# EAGLE schematic Resistor_Resistor (EAGLE 8.3.0), part 38 of 43
## Nets (continued)
N$133: R24801.2 R24802.2 R24803.2 R24804.2 R24805.2 R24806.2 R24807.2 R24808.2 R24809.2 R24810.2 R24811.2 R24812.2 R24813.2 R24814.2 R24815.2 R24816.2 R24817.2 R24818.2 R24819.2 R24820.2 R24821.2 R24822.2 R24823.2 R24824.2 R24825.2 R24826.2 R24827.2 R24828.2 R24829.2 R24830.2 R24831.2 R24832.2 R24833.2 R24834.2 R24835.2 R24836.2 R24837.2 R24838.2 R24839.2 R24840.2 R24841.2 R24842.2 R24843.2 R24844.2 R24845.2 R24846.2 R24847.2 R24848.2 R24849.2 R24850.2 R24851.2 R24852.2 R24853.2 R24854.2 R24855.2 R24856.2 R24857.2 R24858.2 R24859.2 R24860.2 R24861.2 R24862.2 R24863.2 R24864.2 R24865.2 R24866.2 R24867.2 R24868.2 R24869.2 R24870.2 R24871.2 R24872.2 R24873.2 R24874.2 R24875.2 R24876.2 R24877.2 R24878.2 R24879.2 R24880.2 R24881.2 R24882.2 R24883.2 R24884.2 R24885.2 R24886.2 R24887.2 R24888.2 R24889.2 R24890.2 R24891.2 R24892.2 R24893.2 R24894.2 R24895.2 R24896.2 R24897.2 R24898.2 R24899.2 R24900.2 R24901.2 R24902.2 R24903.2 R24904.2 R24905.2 R24906.2 R24907.2 R24908.2 R24909.2 R24910.2 R24911.2 R24912.2 R24913.2 R24914.2 R24915.2 R24916.2 R24917.2 R24918.2 R24919.2 R24920.2 R24921.2 R24922.2 R24923.2 R24924.2 R24925.2 R24926.2 R24927.2 R24928.2 R24929.2 R24930.2 R24931.2 R24932.2 R24933.2 R24934.2 R24935.2 R24936.2 R24937.2 R24938.2 R24939.2 R24940.2 R24941.2 R24942.2 R24943.2 R24944.2 R24945.2 R24946.2 R24947.2 R24948.2 R24949.2 R24950.2 R24951.2 R24952.2 R24953.2 R24954.2 R24955.2 R24956.2 R24957.2 R24958.2 R24959.2 R24960.2 R24961.2 R24962.2 R24963.2 R24964.2 R24965.2 R24966.2 R24967.2 R24968.2 R24969.2 R24970.2 R24971.2 R24972.2 R24973.2 R24974.2 R24975.2 R24976.2 R24977.2 R24978.2 R24979.2 R24980.2 R24981.2 R24982.2 R24983.2 R24984.2 R24985.2 R24986.2 R24987.2 R24988.2 R24989.2 R24990.2 R24991.2 R24992.2 R24993.2 R24994.2 R24995.2 R24996.2 R24997.2 R24998.2 R24999.2 R25000.2 R25001.1 R25002.1 R25003.1 R25004.1 R25005.1 R25006.1 R25007.1 R25008.1 R25009.1 R25010.1 R25011.1 R25012.1 R25013.1 R25014.1 R25015.1 R25016.1 R25017.1 R25018.1 R25019.1 R25020.1 R25021.1 R25022.1 R25023.1 R25024.1 R25025.1 R25026.1 R25027.1 R25028.1 R25029.1 R25030.1 R25031.1 R25032.1 R25033.1 R25034.1 R25035.1 R25036.1 R25037.1 R25038.1 R25039.1 R25040.1 R25041.1 R25042.1 R25043.1 R25044.1 R25045.1 R25046.1 R25047.1 R25048.1 R25049.1 R25050.1 R25051.1 R25052.1 R25053.1 R25054.1 R25055.1 R25056.1 R25057.1 R25058.1 R25059.1 R25060.1 R25061.1 R25062.1 R25063.1 R25064.1 R25065.1 R25066.1 R25067.1 R25068.1 R25069.1 R25070.1 R25071.1 R25072.1 R25073.1 R25074.1 R25075.1 R25076.1 R25077.1 R25078.1 R25079.1 R25080.1 R25081.1 R25082.1 R25083.1 R25084.1 R25085.1 R25086.1 R25087.1 R25088.1 R25089.1 R25090.1 R25091.1 R25092.1 R25093.1 R25094.1 R25095.1 R25096.1 R25097.1 R25098.1 R25099.1 R25100.1 R25101.1 R25102.1 R25103.1 R25104.1 R25105.1 R25106.1 R25107.1 R25108.1 R25109.1 R25110.1 R25111.1 R25112.1 R25113.1 R25114.1 R25115.1 R25116.1 R25117.1 R25118.1 R25119.1 R25120.1 R25121.1 R25122.1 R25123.1 R25124.1 R25125.1 R25126.1 R25127.1 R25128.1 R25129.1 R25130.1 R25131.1 R25132.1 R25133.1 R25134.1 R25135.1 R25136.1 R25137.1 R25138.1 R25139.1 R25140.1 R25141.1 R25142.1 R25143.1 R25144.1 R25145.1 R25146.1 R25147.1 R25148.1 R25149.1 R25150.1 R25151.1 R25152.1 R25153.1 R25154.1 R25155.1 R25156.1 R25157.1 R25158.1 R25159.1 R25160.1 R25161.1 R25162.1 R25163.1 R25164.1 R25165.1 R25166.1 R25167.1 R25168.1 R25169.1 R25170.1 R25171.1 R25172.1 R25173.1 R25174.1 R25175.1 R25176.1 R25177.1 R25178.1 R25179.1 R25180.1 R25181.1 R25182.1 R25183.1 R25184.1 R25185.1 R25186.1 R25187.1 R25188.1 R25189.1 R25190.1 R25191.1 R25192.1 R25193.1 R25194.1 R25195.1 R25196.1 R25197.1 R25198.1 R25199.1 R25200.1
N$134: R25001.2 R25002.2 R25003.2 R25004.2 R25005.2 R25006.2 R25007.2 R25008.2 R25009.2 R25010.2 R25011.2 R25012.2 R25013.2 R25014.2 R25015.2 R25016.2 R25017.2 R25018.2 R25019.2 R25020.2 R25021.2 R25022.2 R25023.2 R25024.2 R25025.2 R25026.2 R25027.2 R25028.2 R25029.2 R25030.2 R25031.2 R25032.2 R25033.2 R25034.2 R25035.2 R25036.2 R25037.2 R25038.2 R25039.2 R25040.2 R25041.2 R25042.2 R25043.2 R25044.2 R25045.2 R25046.2 R25047.2 R25048.2 R25049.2 R25050.2 R25051.2 R25052.2 R25053.2 R25054.2 R25055.2 R25056.2 R25057.2 R25058.2 R25059.2 R25060.2 R25061.2 R25062.2 R25063.2 R25064.2 R25065.2 R25066.2 R25067.2 R25068.2 R25069.2 R25070.2 R25071.2 R25072.2 R25073.2 R25074.2 R25075.2 R25076.2 R25077.2 R25078.2 R25079.2 R25080.2 R25081.2 R25082.2 R25083.2 R25084.2 R25085.2 R25086.2 R25087.2 R25088.2 R25089.2 R25090.2 R25091.2 R25092.2 R25093.2 R25094.2 R25095.2 R25096.2 R25097.2 R25098.2 R25099.2 R25100.2 R25101.2 R25102.2 R25103.2 R25104.2 R25105.2 R25106.2 R25107.2 R25108.2 R25109.2 R25110.2 R25111.2 R25112.2 R25113.2 R25114.2 R25115.2 R25116.2 R25117.2 R25118.2 R25119.2 R25120.2 R25121.2 R25122.2 R25123.2 R25124.2 R25125.2 R25126.2 R25127.2 R25128.2 R25129.2 R25130.2 R25131.2 R25132.2 R25133.2 R25134.2 R25135.2 R25136.2 R25137.2 R25138.2 R25139.2 R25140.2 R25141.2 R25142.2 R25143.2 R25144.2 R25145.2 R25146.2 R25147.2 R25148.2 R25149.2 R25150.2 R25151.2 R25152.2 R25153.2 R25154.2 R25155.2 R25156.2 R25157.2 R25158.2 R25159.2 R25160.2 R25161.2 R25162.2 R25163.2 R25164.2 R25165.2 R25166.2 R25167.2 R25168.2 R25169.2 R25170.2 R25171.2 R25172.2 R25173.2 R25174.2 R25175.2 R25176.2 R25177.2 R25178.2 R25179.2 R25180.2 R25181.2 R25182.2 R25183.2 R25184.2 R25185.2 R25186.2 R25187.2 R25188.2 R25189.2 R25190.2 R25191.2 R25192.2 R25193.2 R25194.2 R25195.2 R25196.2 R25197.2 R25198.2 R25199.2 R25200.2 R25201.1 R25202.1 R25203.1 R25204.1 R25205.1 R25206.1 R25207.1 R25208.1 R25209.1 R25210.1 R25211.1 R25212.1 R25213.1 R25214.1 R25215.1 R25216.1 R25217.1 R25218.1 R25219.1 R25220.1 R25221.1 R25222.1 R25223.1 R25224.1 R25225.1 R25226.1 R25227.1 R25228.1 R25229.1 R25230.1 R25231.1 R25232.1 R25233.1 R25234.1 R25235.1 R25236.1 R25237.1 R25238.1 R25239.1 R25240.1 R25241.1 R25242.1 R25243.1 R25244.1 R25245.1 R25246.1 R25247.1 R25248.1 R25249.1 R25250.1 R25251.1 R25252.1 R25253.1 R25254.1 R25255.1 R25256.1 R25257.1 R25258.1 R25259.1 R25260.1 R25261.1 R25262.1 R25263.1 R25264.1 R25265.1 R25266.1 R25267.1 R25268.1 R25269.1 R25270.1 R25271.1 R25272.1 R25273.1 R25274.1 R25275.1 R25276.1 R25277.1 R25278.1 R25279.1 R25280.1 R25281.1 R25282.1 R25283.1 R25284.1 R25285.1 R25286.1 R25287.1 R25288.1 R25289.1 R25290.1 R25291.1 R25292.1 R25293.1 R25294.1 R25295.1 R25296.1 R25297.1 R25298.1 R25299.1 R25300.1 R25301.1 R25302.1 R25303.1 R25304.1 R25305.1 R25306.1 R25307.1 R25308.1 R25309.1 R25310.1 R25311.1 R25312.1 R25313.1 R25314.1 R25315.1 R25316.1 R25317.1 R25318.1 R25319.1 R25320.1 R25321.1 R25322.1 R25323.1 R25324.1 R25325.1 R25326.1 R25327.1 R25328.1 R25329.1 R25330.1 R25331.1 R25332.1 R25333.1 R25334.1 R25335.1 R25336.1 R25337.1 R25338.1 R25339.1 R25340.1 R25341.1 R25342.1 R25343.1 R25344.1 R25345.1 R25346.1 R25347.1 R25348.1 R25349.1 R25350.1 R25351.1 R25352.1 R25353.1 R25354.1 R25355.1 R25356.1 R25357.1 R25358.1 R25359.1 R25360.1 R25361.1 R25362.1 R25363.1 R25364.1 R25365.1 R25366.1 R25367.1 R25368.1 R25369.1 R25370.1 R25371.1 R25372.1 R25373.1 R25374.1 R25375.1 R25376.1 R25377.1 R25378.1 R25379.1 R25380.1 R25381.1 R25382.1 R25383.1 R25384.1 R25385.1 R25386.1 R25387.1 R25388.1 R25389.1 R25390.1 R25391.1 R25392.1 R25393.1 R25394.1 R25395.1 R25396.1 R25397.1 R25398.1 R25399.1 R25400.1
N$135: R25201.2 R25202.2 R25203.2 R25204.2 R25205.2 R25206.2 R25207.2 R25208.2 R25209.2 R25210.2 R25211.2 R25212.2 R25213.2 R25214.2 R25215.2 R25216.2 R25217.2 R25218.2 R25219.2 R25220.2 R25221.2 R25222.2 R25223.2 R25224.2 R25225.2 R25226.2 R25227.2 R25228.2 R25229.2 R25230.2 R25231.2 R25232.2 R25233.2 R25234.2 R25235.2 R25236.2 R25237.2 R25238.2 R25239.2 R25240.2 R25241.2 R25242.2 R25243.2 R25244.2 R25245.2 R25246.2 R25247.2 R25248.2 R25249.2 R25250.2 R25251.2 R25252.2 R25253.2 R25254.2 R25255.2 R25256.2 R25257.2 R25258.2 R25259.2 R25260.2 R25261.2 R25262.2 R25263.2 R25264.2 R25265.2 R25266.2 R25267.2 R25268.2 R25269.2 R25270.2 R25271.2 R25272.2 R25273.2 R25274.2 R25275.2 R25276.2 R25277.2 R25278.2 R25279.2 R25280.2 R25281.2 R25282.2 R25283.2 R25284.2 R25285.2 R25286.2 R25287.2 R25288.2 R25289.2 R25290.2 R25291.2 R25292.2 R25293.2 R25294.2 R25295.2 R25296.2 R25297.2 R25298.2 R25299.2 R25300.2 R25301.2 R25302.2 R25303.2 R25304.2 R25305.2 R25306.2 R25307.2 R25308.2 R25309.2 R25310.2 R25311.2 R25312.2 R25313.2 R25314.2 R25315.2 R25316.2 R25317.2 R25318.2 R25319.2 R25320.2 R25321.2 R25322.2 R25323.2 R25324.2 R25325.2 R25326.2 R25327.2 R25328.2 R25329.2 R25330.2 R25331.2 R25332.2 R25333.2 R25334.2 R25335.2 R25336.2 R25337.2 R25338.2 R25339.2 R25340.2 R25341.2 R25342.2 R25343.2 R25344.2 R25345.2 R25346.2 R25347.2 R25348.2 R25349.2 R25350.2 R25351.2 R25352.2 R25353.2 R25354.2 R25355.2 R25356.2 R25357.2 R25358.2 R25359.2 R25360.2 R25361.2 R25362.2 R25363.2 R25364.2 R25365.2 R25366.2 R25367.2 R25368.2 R25369.2 R25370.2 R25371.2 R25372.2 R25373.2 R25374.2 R25375.2 R25376.2 R25377.2 R25378.2 R25379.2 R25380.2 R25381.2 R25382.2 R25383.2 R25384.2 R25385.2 R25386.2 R25387.2 R25388.2 R25389.2 R25390.2 R25391.2 R25392.2 R25393.2 R25394.2 R25395.2 R25396.2 R25397.2 R25398.2 R25399.2 R25400.2 R25401.1 R25402.1 R25403.1 R25404.1 R25405.1 R25406.1 R25407.1 R25408.1 R25409.1 R25410.1 R25411.1 R25412.1 R25413.1 R25414.1 R25415.1 R25416.1 R25417.1 R25418.1 R25419.1 R25420.1 R25421.1 R25422.1 R25423.1 R25424.1 R25425.1 R25426.1 R25427.1 R25428.1 R25429.1 R25430.1 R25431.1 R25432.1 R25433.1 R25434.1 R25435.1 R25436.1 R25437.1 R25438.1 R25439.1 R25440.1 R25441.1 R25442.1 R25443.1 R25444.1 R25445.1 R25446.1 R25447.1 R25448.1 R25449.1 R25450.1 R25451.1 R25452.1 R25453.1 R25454.1 R25455.1 R25456.1 R25457.1 R25458.1 R25459.1 R25460.1 R25461.1 R25462.1 R25463.1 R25464.1 R25465.1 R25466.1 R25467.1 R25468.1 R25469.1 R25470.1 R25471.1 R25472.1 R25473.1 R25474.1 R25475.1 R25476.1 R25477.1 R25478.1 R25479.1 R25480.1 R25481.1 R25482.1 R25483.1 R25484.1 R25485.1 R25486.1 R25487.1 R25488.1 R25489.1 R25490.1 R25491.1 R25492.1 R25493.1 R25494.1 R25495.1 R25496.1 R25497.1 R25498.1 R25499.1 R25500.1 R25501.1 R25502.1 R25503.1 R25504.1 R25505.1 R25506.1 R25507.1 R25508.1 R25509.1 R25510.1 R25511.1 R25512.1 R25513.1 R25514.1 R25515.1 R25516.1 R25517.1 R25518.1 R25519.1 R25520.1 R25521.1 R25522.1 R25523.1 R25524.1 R25525.1 R25526.1 R25527.1 R25528.1 R25529.1 R25530.1 R25531.1 R25532.1 R25533.1 R25534.1 R25535.1 R25536.1 R25537.1 R25538.1 R25539.1 R25540.1 R25541.1 R25542.1 R25543.1 R25544.1 R25545.1 R25546.1 R25547.1 R25548.1 R25549.1 R25550.1 R25551.1 R25552.1 R25553.1 R25554.1 R25555.1 R25556.1 R25557.1 R25558.1 R25559.1 R25560.1 R25561.1 R25562.1 R25563.1 R25564.1 R25565.1 R25566.1 R25567.1 R25568.1 R25569.1 R25570.1 R25571.1 R25572.1 R25573.1 R25574.1 R25575.1 R25576.1 R25577.1 R25578.1 R25579.1 R25580.1 R25581.1 R25582.1 R25583.1 R25584.1 R25585.1 R25586.1 R25587.1 R25588.1 R25589.1 R25590.1 R25591.1 R25592.1 R25593.1 R25594.1 R25595.1 R25596.1 R25597.1 R25598.1 R25599.1 R25600.1
N$136: R25401.2 R25402.2 R25403.2 R25404.2 R25405.2 R25406.2 R25407.2 R25408.2 R25409.2 R25410.2 R25411.2 R25412.2 R25413.2 R25414.2 R25415.2 R25416.2 R25417.2 R25418.2 R25419.2 R25420.2 R25421.2 R25422.2 R25423.2 R25424.2 R25425.2 R25426.2 R25427.2 R25428.2 R25429.2 R25430.2 R25431.2 R25432.2 R25433.2 R25434.2 R25435.2 R25436.2 R25437.2 R25438.2 R25439.2 R25440.2 R25441.2 R25442.2 R25443.2 R25444.2 R25445.2 R25446.2 R25447.2 R25448.2 R25449.2 R25450.2 R25451.2 R25452.2 R25453.2 R25454.2 R25455.2 R25456.2 R25457.2 R25458.2 R25459.2 R25460.2 R25461.2 R25462.2 R25463.2 R25464.2 R25465.2 R25466.2 R25467.2 R25468.2 R25469.2 R25470.2 R25471.2 R25472.2 R25473.2 R25474.2 R25475.2 R25476.2 R25477.2 R25478.2 R25479.2 R25480.2 R25481.2 R25482.2 R25483.2 R25484.2 R25485.2 R25486.2 R25487.2 R25488.2 R25489.2 R25490.2 R25491.2 R25492.2 R25493.2 R25494.2 R25495.2 R25496.2 R25497.2 R25498.2 R25499.2 R25500.2 R25501.2 R25502.2 R25503.2 R25504.2 R25505.2 R25506.2 R25507.2 R25508.2 R25509.2 R25510.2 R25511.2 R25512.2 R25513.2 R25514.2 R25515.2 R25516.2 R25517.2 R25518.2 R25519.2 R25520.2 R25521.2 R25522.2 R25523.2 R25524.2 R25525.2 R25526.2 R25527.2 R25528.2 R25529.2 R25530.2 R25531.2 R25532.2 R25533.2 R25534.2 R25535.2 R25536.2 R25537.2 R25538.2 R25539.2 R25540.2 R25541.2 R25542.2 R25543.2 R25544.2 R25545.2 R25546.2 R25547.2 R25548.2 R25549.2 R25550.2 R25551.2 R25552.2 R25553.2 R25554.2 R25555.2 R25556.2 R25557.2 R25558.2 R25559.2 R25560.2 R25561.2 R25562.2 R25563.2 R25564.2 R25565.2 R25566.2 R25567.2 R25568.2 R25569.2 R25570.2 R25571.2 R25572.2 R25573.2 R25574.2 R25575.2 R25576.2 R25577.2 R25578.2 R25579.2 R25580.2 R25581.2 R25582.2 R25583.2 R25584.2 R25585.2 R25586.2 R25587.2 R25588.2 R25589.2 R25590.2 R25591.2 R25592.2 R25593.2 R25594.2 R25595.2 R25596.2 R25597.2 R25598.2 R25599.2 R25600.2 R25601.1 R25602.1 R25603.1 R25604.1 R25605.1 R25606.1 R25607.1 R25608.1 R25609.1 R25610.1 R25611.1 R25612.1 R25613.1 R25614.1 R25615.1 R25616.1 R25617.1 R25618.1 R25619.1 R25620.1 R25621.1 R25622.1 R25623.1 R25624.1 R25625.1 R25626.1 R25627.1 R25628.1 R25629.1 R25630.1 R25631.1 R25632.1 R25633.1 R25634.1 R25635.1 R25636.1 R25637.1 R25638.1 R25639.1 R25640.1 R25641.1 R25642.1 R25643.1 R25644.1 R25645.1 R25646.1 R25647.1 R25648.1 R25649.1 R25650.1 R25651.1 R25652.1 R25653.1 R25654.1 R25655.1 R25656.1 R25657.1 R25658.1 R25659.1 R25660.1 R25661.1 R25662.1 R25663.1 R25664.1 R25665.1 R25666.1 R25667.1 R25668.1 R25669.1 R25670.1 R25671.1 R25672.1 R25673.1 R25674.1 R25675.1 R25676.1 R25677.1 R25678.1 R25679.1 R25680.1 R25681.1 R25682.1 R25683.1 R25684.1 R25685.1 R25686.1 R25687.1 R25688.1 R25689.1 R25690.1 R25691.1 R25692.1 R25693.1 R25694.1 R25695.1 R25696.1 R25697.1 R25698.1 R25699.1 R25700.1 R25701.1 R25702.1 R25703.1 R25704.1 R25705.1 R25706.1 R25707.1 R25708.1 R25709.1 R25710.1 R25711.1 R25712.1 R25713.1 R25714.1 R25715.1 R25716.1 R25717.1 R25718.1 R25719.1 R25720.1 R25721.1 R25722.1 R25723.1 R25724.1 R25725.1 R25726.1 R25727.1 R25728.1 R25729.1 R25730.1 R25731.1 R25732.1 R25733.1 R25734.1 R25735.1 R25736.1 R25737.1 R25738.1 R25739.1 R25740.1 R25741.1 R25742.1 R25743.1 R25744.1 R25745.1 R25746.1 R25747.1 R25748.1 R25749.1 R25750.1 R25751.1 R25752.1 R25753.1 R25754.1 R25755.1 R25756.1 R25757.1 R25758.1 R25759.1 R25760.1 R25761.1 R25762.1 R25763.1 R25764.1 R25765.1 R25766.1 R25767.1 R25768.1 R25769.1 R25770.1 R25771.1 R25772.1 R25773.1 R25774.1 R25775.1 R25776.1 R25777.1 R25778.1 R25779.1 R25780.1 R25781.1 R25782.1 R25783.1 R25784.1 R25785.1 R25786.1 R25787.1 R25788.1 R25789.1 R25790.1 R25791.1 R25792.1 R25793.1 R25794.1 R25795.1 R25796.1 R25797.1 R25798.1 R25799.1 R25800.1
N$138: R25601.2 R25602.2 R25603.2 R25604.2 R25605.2 R25606.2 R25607.2 R25608.2 R25609.2 R25610.2 R25611.2 R25612.2 R25613.2 R25614.2 R25615.2 R25616.2 R25617.2 R25618.2 R25619.2 R25620.2 R25621.2 R25622.2 R25623.2 R25624.2 R25625.2 R25626.2 R25627.2 R25628.2 R25629.2 R25630.2 R25631.2 R25632.2 R25633.2 R25634.2 R25635.2 R25636.2 R25637.2 R25638.2 R25639.2 R25640.2 R25641.2 R25642.2 R25643.2 R25644.2 R25645.2 R25646.2 R25647.2 R25648.2 R25649.2 R25650.2 R25651.2 R25652.2 R25653.2 R25654.2 R25655.2 R25656.2 R25657.2 R25658.2 R25659.2 R25660.2 R25661.2 R25662.2 R25663.2 R25664.2 R25665.2 R25666.2 R25667.2 R25668.2 R25669.2 R25670.2 R25671.2 R25672.2 R25673.2 R25674.2 R25675.2 R25676.2 R25677.2 R25678.2 R25679.2 R25680.2 R25681.2 R25682.2 R25683.2 R25684.2 R25685.2 R25686.2 R25687.2 R25688.2 R25689.2 R25690.2 R25691.2 R25692.2 R25693.2 R25694.2 R25695.2 R25696.2 R25697.2 R25698.2 R25699.2 R25700.2 R25701.2 R25702.2 R25703.2 R25704.2 R25705.2 R25706.2 R25707.2 R25708.2 R25709.2 R25710.2 R25711.2 R25712.2 R25713.2 R25714.2 R25715.2 R25716.2 R25717.2 R25718.2 R25719.2 R25720.2 R25721.2 R25722.2 R25723.2 R25724.2 R25725.2 R25726.2 R25727.2 R25728.2 R25729.2 R25730.2 R25731.2 R25732.2 R25733.2 R25734.2 R25735.2 R25736.2 R25737.2 R25738.2 R25739.2 R25740.2 R25741.2 R25742.2 R25743.2 R25744.2 R25745.2 R25746.2 R25747.2 R25748.2 R25749.2 R25750.2 R25751.2 R25752.2 R25753.2 R25754.2 R25755.2 R25756.2 R25757.2 R25758.2 R25759.2 R25760.2 R25761.2 R25762.2 R25763.2 R25764.2 R25765.2 R25766.2 R25767.2 R25768.2 R25769.2 R25770.2 R25771.2 R25772.2 R25773.2 R25774.2 R25775.2 R25776.2 R25777.2 R25778.2 R25779.2 R25780.2 R25781.2 R25782.2 R25783.2 R25784.2 R25785.2 R25786.2 R25787.2 R25788.2 R25789.2 R25790.2 R25791.2 R25792.2 R25793.2 R25794.2 R25795.2 R25796.2 R25797.2 R25798.2 R25799.2 R25800.2 R25801.1 R25802.1 R25803.1 R25804.1 R25805.1 R25806.1 R25807.1 R25808.1 R25809.1 R25810.1 R25811.1 R25812.1 R25813.1 R25814.1 R25815.1 R25816.1 R25817.1 R25818.1 R25819.1 R25820.1 R25821.1 R25822.1 R25823.1 R25824.1 R25825.1 R25826.1 R25827.1 R25828.1 R25829.1 R25830.1 R25831.1 R25832.1 R25833.1 R25834.1 R25835.1 R25836.1 R25837.1 R25838.1 R25839.1 R25840.1 R25841.1 R25842.1 R25843.1 R25844.1 R25845.1 R25846.1 R25847.1 R25848.1 R25849.1 R25850.1 R25851.1 R25852.1 R25853.1 R25854.1 R25855.1 R25856.1 R25857.1 R25858.1 R25859.1 R25860.1 R25861.1 R25862.1 R25863.1 R25864.1 R25865.1 R25866.1 R25867.1 R25868.1 R25869.1 R25870.1 R25871.1 R25872.1 R25873.1 R25874.1 R25875.1 R25876.1 R25877.1 R25878.1 R25879.1 R25880.1 R25881.1 R25882.1 R25883.1 R25884.1 R25885.1 R25886.1 R25887.1 R25888.1 R25889.1 R25890.1 R25891.1 R25892.1 R25893.1 R25894.1 R25895.1 R25896.1 R25897.1 R25898.1 R25899.1 R25900.1 R25901.1 R25902.1 R25903.1 R25904.1 R25905.1 R25906.1 R25907.1 R25908.1 R25909.1 R25910.1 R25911.1 R25912.1 R25913.1 R25914.1 R25915.1 R25916.1 R25917.1 R25918.1 R25919.1 R25920.1 R25921.1 R25922.1 R25923.1 R25924.1 R25925.1 R25926.1 R25927.1 R25928.1 R25929.1 R25930.1 R25931.1 R25932.1 R25933.1 R25934.1 R25935.1 R25936.1 R25937.1 R25938.1 R25939.1 R25940.1 R25941.1 R25942.1 R25943.1 R25944.1 R25945.1 R25946.1 R25947.1 R25948.1 R25949.1 R25950.1 R25951.1 R25952.1 R25953.1 R25954.1 R25955.1 R25956.1 R25957.1 R25958.1 R25959.1 R25960.1 R25961.1 R25962.1 R25963.1 R25964.1 R25965.1 R25966.1 R25967.1 R25968.1 R25969.1 R25970.1 R25971.1 R25972.1 R25973.1 R25974.1 R25975.1 R25976.1 R25977.1 R25978.1 R25979.1 R25980.1 R25981.1 R25982.1 R25983.1 R25984.1 R25985.1 R25986.1 R25987.1 R25988.1 R25989.1 R25990.1 R25991.1 R25992.1 R25993.1 R25994.1 R25995.1 R25996.1 R25997.1 R25998.1 R25999.1 R26000.1
N$139: R25801.2 R25802.2 R25803.2 R25804.2 R25805.2 R25806.2 R25807.2 R25808.2 R25809.2 R25810.2 R25811.2 R25812.2 R25813.2 R25814.2 R25815.2 R25816.2 R25817.2 R25818.2 R25819.2 R25820.2 R25821.2 R25822.2 R25823.2 R25824.2 R25825.2 R25826.2 R25827.2 R25828.2 R25829.2 R25830.2 R25831.2 R25832.2 R25833.2 R25834.2 R25835.2 R25836.2 R25837.2 R25838.2 R25839.2 R25840.2 R25841.2 R25842.2 R25843.2 R25844.2 R25845.2 R25846.2 R25847.2 R25848.2 R25849.2 R25850.2 R25851.2 R25852.2 R25853.2 R25854.2 R25855.2 R25856.2 R25857.2 R25858.2 R25859.2 R25860.2 R25861.2 R25862.2 R25863.2 R25864.2 R25865.2 R25866.2 R25867.2 R25868.2 R25869.2 R25870.2 R25871.2 R25872.2 R25873.2 R25874.2 R25875.2 R25876.2 R25877.2 R25878.2 R25879.2 R25880.2 R25881.2 R25882.2 R25883.2 R25884.2 R25885.2 R25886.2 R25887.2 R25888.2 R25889.2 R25890.2 R25891.2 R25892.2 R25893.2 R25894.2 R25895.2 R25896.2 R25897.2 R25898.2 R25899.2 R25900.2 R25901.2 R25902.2 R25903.2 R25904.2 R25905.2 R25906.2 R25907.2 R25908.2 R25909.2 R25910.2 R25911.2 R25912.2 R25913.2 R25914.2 R25915.2 R25916.2 R25917.2 R25918.2 R25919.2 R25920.2 R25921.2 R25922.2 R25923.2 R25924.2 R25925.2 R25926.2 R25927.2 R25928.2 R25929.2 R25930.2 R25931.2 R25932.2 R25933.2 R25934.2 R25935.2 R25936.2 R25937.2 R25938.2 R25939.2 R25940.2 R25941.2 R25942.2 R25943.2 R25944.2 R25945.2 R25946.2 R25947.2 R25948.2 R25949.2 R25950.2 R25951.2 R25952.2 R25953.2 R25954.2 R25955.2 R25956.2 R25957.2 R25958.2 R25959.2 R25960.2 R25961.2 R25962.2 R25963.2 R25964.2 R25965.2 R25966.2 R25967.2 R25968.2 R25969.2 R25970.2 R25971.2 R25972.2 R25973.2 R25974.2 R25975.2 R25976.2 R25977.2 R25978.2 R25979.2 R25980.2 R25981.2 R25982.2 R25983.2 R25984.2 R25985.2 R25986.2 R25987.2 R25988.2 R25989.2 R25990.2 R25991.2 R25992.2 R25993.2 R25994.2 R25995.2 R25996.2 R25997.2 R25998.2 R25999.2 R26000.2 R26001.1 R26002.1 R26003.1 R26004.1 R26005.1 R26006.1 R26007.1 R26008.1 R26009.1 R26010.1 R26011.1 R26012.1 R26013.1 R26014.1 R26015.1 R26016.1 R26017.1 R26018.1 R26019.1 R26020.1 R26021.1 R26022.1 R26023.1 R26024.1 R26025.1 R26026.1 R26027.1 R26028.1 R26029.1 R26030.1 R26031.1 R26032.1 R26033.1 R26034.1 R26035.1 R26036.1 R26037.1 R26038.1 R26039.1 R26040.1 R26041.1 R26042.1 R26043.1 R26044.1 R26045.1 R26046.1 R26047.1 R26048.1 R26049.1 R26050.1 R26051.1 R26052.1 R26053.1 R26054.1 R26055.1 R26056.1 R26057.1 R26058.1 R26059.1 R26060.1 R26061.1 R26062.1 R26063.1 R26064.1 R26065.1 R26066.1 R26067.1 R26068.1 R26069.1 R26070.1 R26071.1 R26072.1 R26073.1 R26074.1 R26075.1 R26076.1 R26077.1 R26078.1 R26079.1 R26080.1 R26081.1 R26082.1 R26083.1 R26084.1 R26085.1 R26086.1 R26087.1 R26088.1 R26089.1 R26090.1 R26091.1 R26092.1 R26093.1 R26094.1 R26095.1 R26096.1 R26097.1 R26098.1 R26099.1 R26100.1 R26101.1 R26102.1 R26103.1 R26104.1 R26105.1 R26106.1 R26107.1 R26108.1 R26109.1 R26110.1 R26111.1 R26112.1 R26113.1 R26114.1 R26115.1 R26116.1 R26117.1 R26118.1 R26119.1 R26120.1 R26121.1 R26122.1 R26123.1 R26124.1 R26125.1 R26126.1 R26127.1 R26128.1 R26129.1 R26130.1 R26131.1 R26132.1 R26133.1 R26134.1 R26135.1 R26136.1 R26137.1 R26138.1 R26139.1 R26140.1 R26141.1 R26142.1 R26143.1 R26144.1 R26145.1 R26146.1 R26147.1 R26148.1 R26149.1 R26150.1 R26151.1 R26152.1 R26153.1 R26154.1 R26155.1 R26156.1 R26157.1 R26158.1 R26159.1 R26160.1 R26161.1 R26162.1 R26163.1 R26164.1 R26165.1 R26166.1 R26167.1 R26168.1 R26169.1 R26170.1 R26171.1 R26172.1 R26173.1 R26174.1 R26175.1 R26176.1 R26177.1 R26178.1 R26179.1 R26180.1 R26181.1 R26182.1 R26183.1 R26184.1 R26185.1 R26186.1 R26187.1 R26188.1 R26189.1 R26190.1 R26191.1 R26192.1 R26193.1 R26194.1 R26195.1 R26196.1 R26197.1 R26198.1 R26199.1 R26200.1
N$140: R26001.2 R26002.2 R26003.2 R26004.2 R26005.2 R26006.2 R26007.2 R26008.2 R26009.2 R26010.2 R26011.2 R26012.2 R26013.2 R26014.2 R26015.2 R26016.2 R26017.2 R26018.2 R26019.2 R26020.2 R26021.2 R26022.2 R26023.2 R26024.2 R26025.2 R26026.2 R26027.2 R26028.2 R26029.2 R26030.2 R26031.2 R26032.2 R26033.2 R26034.2 R26035.2 R26036.2 R26037.2 R26038.2 R26039.2 R26040.2 R26041.2 R26042.2 R26043.2 R26044.2 R26045.2 R26046.2 R26047.2 R26048.2 R26049.2 R26050.2 R26051.2 R26052.2 R26053.2 R26054.2 R26055.2 R26056.2 R26057.2 R26058.2 R26059.2 R26060.2 R26061.2 R26062.2 R26063.2 R26064.2 R26065.2 R26066.2 R26067.2 R26068.2 R26069.2 R26070.2 R26071.2 R26072.2 R26073.2 R26074.2 R26075.2 R26076.2 R26077.2 R26078.2 R26079.2 R26080.2 R26081.2 R26082.2 R26083.2 R26084.2 R26085.2 R26086.2 R26087.2 R26088.2 R26089.2 R26090.2 R26091.2 R26092.2 R26093.2 R26094.2 R26095.2 R26096.2 R26097.2 R26098.2 R26099.2 R26100.2 R26101.2 R26102.2 R26103.2 R26104.2 R26105.2 R26106.2 R26107.2 R26108.2 R26109.2 R26110.2 R26111.2 R26112.2 R26113.2 R26114.2 R26115.2 R26116.2 R26117.2 R26118.2 R26119.2 R26120.2 R26121.2 R26122.2 R26123.2 R26124.2 R26125.2 R26126.2 R26127.2 R26128.2 R26129.2 R26130.2 R26131.2 R26132.2 R26133.2 R26134.2 R26135.2 R26136.2 R26137.2 R26138.2 R26139.2 R26140.2 R26141.2 R26142.2 R26143.2 R26144.2 R26145.2 R26146.2 R26147.2 R26148.2 R26149.2 R26150.2 R26151.2 R26152.2 R26153.2 R26154.2 R26155.2 R26156.2 R26157.2 R26158.2 R26159.2 R26160.2 R26161.2 R26162.2 R26163.2 R26164.2 R26165.2 R26166.2 R26167.2 R26168.2 R26169.2 R26170.2 R26171.2 R26172.2 R26173.2 R26174.2 R26175.2 R26176.2 R26177.2 R26178.2 R26179.2 R26180.2 R26181.2 R26182.2 R26183.2 R26184.2 R26185.2 R26186.2 R26187.2 R26188.2 R26189.2 R26190.2 R26191.2 R26192.2 R26193.2 R26194.2 R26195.2 R26196.2 R26197.2 R26198.2 R26199.2 R26200.2 R26201.1 R26202.1 R26203.1 R26204.1 R26205.1 R26206.1 R26207.1 R26208.1 R26209.1 R26210.1 R26211.1 R26212.1 R26213.1 R26214.1 R26215.1 R26216.1 R26217.1 R26218.1 R26219.1 R26220.1 R26221.1 R26222.1 R26223.1 R26224.1 R26225.1 R26226.1 R26227.1 R26228.1 R26229.1 R26230.1 R26231.1 R26232.1 R26233.1 R26234.1 R26235.1 R26236.1 R26237.1 R26238.1 R26239.1 R26240.1 R26241.1 R26242.1 R26243.1 R26244.1 R26245.1 R26246.1 R26247.1 R26248.1 R26249.1 R26250.1 R26251.1 R26252.1 R26253.1 R26254.1 R26255.1 R26256.1 R26257.1 R26258.1 R26259.1 R26260.1 R26261.1 R26262.1 R26263.1 R26264.1 R26265.1 R26266.1 R26267.1 R26268.1 R26269.1 R26270.1 R26271.1 R26272.1 R26273.1 R26274.1 R26275.1 R26276.1 R26277.1 R26278.1 R26279.1 R26280.1 R26281.1 R26282.1 R26283.1 R26284.1 R26285.1 R26286.1 R26287.1 R26288.1 R26289.1 R26290.1 R26291.1 R26292.1 R26293.1 R26294.1 R26295.1 R26296.1 R26297.1 R26298.1 R26299.1 R26300.1 R26301.1 R26302.1 R26303.1 R26304.1 R26305.1 R26306.1 R26307.1 R26308.1 R26309.1 R26310.1 R26311.1 R26312.1 R26313.1 R26314.1 R26315.1 R26316.1 R26317.1 R26318.1 R26319.1 R26320.1 R26321.1 R26322.1 R26323.1 R26324.1 R26325.1 R26326.1 R26327.1 R26328.1 R26329.1 R26330.1 R26331.1 R26332.1 R26333.1 R26334.1 R26335.1 R26336.1 R26337.1 R26338.1 R26339.1 R26340.1 R26341.1 R26342.1 R26343.1 R26344.1 R26345.1 R26346.1 R26347.1 R26348.1 R26349.1 R26350.1 R26351.1 R26352.1 R26353.1 R26354.1 R26355.1 R26356.1 R26357.1 R26358.1 R26359.1 R26360.1 R26361.1 R26362.1 R26363.1 R26364.1 R26365.1 R26366.1 R26367.1 R26368.1 R26369.1 R26370.1 R26371.1 R26372.1 R26373.1 R26374.1 R26375.1 R26376.1 R26377.1 R26378.1 R26379.1 R26380.1 R26381.1 R26382.1 R26383.1 R26384.1 R26385.1 R26386.1 R26387.1 R26388.1 R26389.1 R26390.1 R26391.1 R26392.1 R26393.1 R26394.1 R26395.1 R26396.1 R26397.1 R26398.1 R26399.1 R26400.1
N$141: R26201.2 R26202.2 R26203.2 R26204.2 R26205.2 R26206.2 R26207.2 R26208.2 R26209.2 R26210.2 R26211.2 R26212.2 R26213.2 R26214.2 R26215.2 R26216.2 R26217.2 R26218.2 R26219.2 R26220.2 R26221.2 R26222.2 R26223.2 R26224.2 R26225.2 R26226.2 R26227.2 R26228.2 R26229.2 R26230.2 R26231.2 R26232.2 R26233.2 R26234.2 R26235.2 R26236.2 R26237.2 R26238.2 R26239.2 R26240.2 R26241.2 R26242.2 R26243.2 R26244.2 R26245.2 R26246.2 R26247.2 R26248.2 R26249.2 R26250.2 R26251.2 R26252.2 R26253.2 R26254.2 R26255.2 R26256.2 R26257.2 R26258.2 R26259.2 R26260.2 R26261.2 R26262.2 R26263.2 R26264.2 R26265.2 R26266.2 R26267.2 R26268.2 R26269.2 R26270.2 R26271.2 R26272.2 R26273.2 R26274.2 R26275.2 R26276.2 R26277.2 R26278.2 R26279.2 R26280.2 R26281.2 R26282.2 R26283.2 R26284.2 R26285.2 R26286.2 R26287.2 R26288.2 R26289.2 R26290.2 R26291.2 R26292.2 R26293.2 R26294.2 R26295.2 R26296.2 R26297.2 R26298.2 R26299.2 R26300.2 R26301.2 R26302.2 R26303.2 R26304.2 R26305.2 R26306.2 R26307.2 R26308.2 R26309.2 R26310.2 R26311.2 R26312.2 R26313.2 R26314.2 R26315.2 R26316.2 R26317.2 R26318.2 R26319.2 R26320.2 R26321.2 R26322.2 R26323.2 R26324.2 R26325.2 R26326.2 R26327.2 R26328.2 R26329.2 R26330.2 R26331.2 R26332.2 R26333.2 R26334.2 R26335.2 R26336.2 R26337.2 R26338.2 R26339.2 R26340.2 R26341.2 R26342.2 R26343.2 R26344.2 R26345.2 R26346.2 R26347.2 R26348.2 R26349.2 R26350.2 R26351.2 R26352.2 R26353.2 R26354.2 R26355.2 R26356.2 R26357.2 R26358.2 R26359.2 R26360.2 R26361.2 R26362.2 R26363.2 R26364.2 R26365.2 R26366.2 R26367.2 R26368.2 R26369.2 R26370.2 R26371.2 R26372.2 R26373.2 R26374.2 R26375.2 R26376.2 R26377.2 R26378.2 R26379.2 R26380.2 R26381.2 R26382.2 R26383.2 R26384.2 R26385.2 R26386.2 R26387.2 R26388.2 R26389.2 R26390.2 R26391.2 R26392.2 R26393.2 R26394.2 R26395.2 R26396.2 R26397.2 R26398.2 R26399.2 R26400.2 R26401.1 R26402.1 R26403.1 R26404.1 R26405.1 R26406.1 R26407.1 R26408.1 R26409.1 R26410.1 R26411.1 R26412.1 R26413.1 R26414.1 R26415.1 R26416.1 R26417.1 R26418.1 R26419.1 R26420.1 R26421.1 R26422.1 R26423.1 R26424.1 R26425.1 R26426.1 R26427.1 R26428.1 R26429.1 R26430.1 R26431.1 R26432.1 R26433.1 R26434.1 R26435.1 R26436.1 R26437.1 R26438.1 R26439.1 R26440.1 R26441.1 R26442.1 R26443.1 R26444.1 R26445.1 R26446.1 R26447.1 R26448.1 R26449.1 R26450.1 R26451.1 R26452.1 R26453.1 R26454.1 R26455.1 R26456.1 R26457.1 R26458.1 R26459.1 R26460.1 R26461.1 R26462.1 R26463.1 R26464.1 R26465.1 R26466.1 R26467.1 R26468.1 R26469.1 R26470.1 R26471.1 R26472.1 R26473.1 R26474.1 R26475.1 R26476.1 R26477.1 R26478.1 R26479.1 R26480.1 R26481.1 R26482.1 R26483.1 R26484.1 R26485.1 R26486.1 R26487.1 R26488.1 R26489.1 R26490.1 R26491.1 R26492.1 R26493.1 R26494.1 R26495.1 R26496.1 R26497.1 R26498.1 R26499.1 R26500.1 R26501.1 R26502.1 R26503.1 R26504.1 R26505.1 R26506.1 R26507.1 R26508.1 R26509.1 R26510.1 R26511.1 R26512.1 R26513.1 R26514.1 R26515.1 R26516.1 R26517.1 R26518.1 R26519.1 R26520.1 R26521.1 R26522.1 R26523.1 R26524.1 R26525.1 R26526.1 R26527.1 R26528.1 R26529.1 R26530.1 R26531.1 R26532.1 R26533.1 R26534.1 R26535.1 R26536.1 R26537.1 R26538.1 R26539.1 R26540.1 R26541.1 R26542.1 R26543.1 R26544.1 R26545.1 R26546.1 R26547.1 R26548.1 R26549.1 R26550.1 R26551.1 R26552.1 R26553.1 R26554.1 R26555.1 R26556.1 R26557.1 R26558.1 R26559.1 R26560.1 R26561.1 R26562.1 R26563.1 R26564.1 R26565.1 R26566.1 R26567.1 R26568.1 R26569.1 R26570.1 R26571.1 R26572.1 R26573.1 R26574.1 R26575.1 R26576.1 R26577.1 R26578.1 R26579.1 R26580.1 R26581.1 R26582.1 R26583.1 R26584.1 R26585.1 R26586.1 R26587.1 R26588.1 R26589.1 R26590.1 R26591.1 R26592.1 R26593.1 R26594.1 R26595.1 R26596.1 R26597.1 R26598.1 R26599.1 R26600.1
N$142: R26401.2 R26402.2 R26403.2 R26404.2 R26405.2 R26406.2 R26407.2 R26408.2 R26409.2 R26410.2 R26411.2 R26412.2 R26413.2 R26414.2 R26415.2 R26416.2 R26417.2 R26418.2 R26419.2 R26420.2 R26421.2 R26422.2 R26423.2 R26424.2 R26425.2 R26426.2 R26427.2 R26428.2 R26429.2 R26430.2 R26431.2 R26432.2 R26433.2 R26434.2 R26435.2 R26436.2 R26437.2 R26438.2 R26439.2 R26440.2 R26441.2 R26442.2 R26443.2 R26444.2 R26445.2 R26446.2 R26447.2 R26448.2 R26449.2 R26450.2 R26451.2 R26452.2 R26453.2 R26454.2 R26455.2 R26456.2 R26457.2 R26458.2 R26459.2 R26460.2 R26461.2 R26462.2 R26463.2 R26464.2 R26465.2 R26466.2 R26467.2 R26468.2 R26469.2 R26470.2 R26471.2 R26472.2 R26473.2 R26474.2 R26475.2 R26476.2 R26477.2 R26478.2 R26479.2 R26480.2 R26481.2 R26482.2 R26483.2 R26484.2 R26485.2 R26486.2 R26487.2 R26488.2 R26489.2 R26490.2 R26491.2 R26492.2 R26493.2 R26494.2 R26495.2 R26496.2 R26497.2 R26498.2 R26499.2 R26500.2 R26501.2 R26502.2 R26503.2 R26504.2 R26505.2 R26506.2 R26507.2 R26508.2 R26509.2 R26510.2 R26511.2 R26512.2 R26513.2 R26514.2 R26515.2 R26516.2 R26517.2 R26518.2 R26519.2 R26520.2 R26521.2 R26522.2 R26523.2 R26524.2 R26525.2 R26526.2 R26527.2 R26528.2 R26529.2 R26530.2 R26531.2 R26532.2 R26533.2 R26534.2 R26535.2 R26536.2 R26537.2 R26538.2 R26539.2 R26540.2 R26541.2 R26542.2 R26543.2 R26544.2 R26545.2 R26546.2 R26547.2 R26548.2 R26549.2 R26550.2 R26551.2 R26552.2 R26553.2 R26554.2 R26555.2 R26556.2 R26557.2 R26558.2 R26559.2 R26560.2 R26561.2 R26562.2 R26563.2 R26564.2 R26565.2 R26566.2 R26567.2 R26568.2 R26569.2 R26570.2 R26571.2 R26572.2 R26573.2 R26574.2 R26575.2 R26576.2 R26577.2 R26578.2 R26579.2 R26580.2 R26581.2 R26582.2 R26583.2 R26584.2 R26585.2 R26586.2 R26587.2 R26588.2 R26589.2 R26590.2 R26591.2 R26592.2 R26593.2 R26594.2 R26595.2 R26596.2 R26597.2 R26598.2 R26599.2 R26600.2 R26601.1 R26602.1 R26603.1 R26604.1 R26605.1 R26606.1 R26607.1 R26608.1 R26609.1 R26610.1 R26611.1 R26612.1 R26613.1 R26614.1 R26615.1 R26616.1 R26617.1 R26618.1 R26619.1 R26620.1 R26621.1 R26622.1 R26623.1 R26624.1 R26625.1 R26626.1 R26627.1 R26628.1 R26629.1 R26630.1 R26631.1 R26632.1 R26633.1 R26634.1 R26635.1 R26636.1 R26637.1 R26638.1 R26639.1 R26640.1 R26641.1 R26642.1 R26643.1 R26644.1 R26645.1 R26646.1 R26647.1 R26648.1 R26649.1 R26650.1 R26651.1 R26652.1 R26653.1 R26654.1 R26655.1 R26656.1 R26657.1 R26658.1 R26659.1 R26660.1 R26661.1 R26662.1 R26663.1 R26664.1 R26665.1 R26666.1 R26667.1 R26668.1 R26669.1 R26670.1 R26671.1 R26672.1 R26673.1 R26674.1 R26675.1 R26676.1 R26677.1 R26678.1 R26679.1 R26680.1 R26681.1 R26682.1 R26683.1 R26684.1 R26685.1 R26686.1 R26687.1 R26688.1 R26689.1 R26690.1 R26691.1 R26692.1 R26693.1 R26694.1 R26695.1 R26696.1 R26697.1 R26698.1 R26699.1 R26700.1 R26701.1 R26702.1 R26703.1 R26704.1 R26705.1 R26706.1 R26707.1 R26708.1 R26709.1 R26710.1 R26711.1 R26712.1 R26713.1 R26714.1 R26715.1 R26716.1 R26717.1 R26718.1 R26719.1 R26720.1 R26721.1 R26722.1 R26723.1 R26724.1 R26725.1 R26726.1 R26727.1 R26728.1 R26729.1 R26730.1 R26731.1 R26732.1 R26733.1 R26734.1 R26735.1 R26736.1 R26737.1 R26738.1 R26739.1 R26740.1 R26741.1 R26742.1 R26743.1 R26744.1 R26745.1 R26746.1 R26747.1 R26748.1 R26749.1 R26750.1 R26751.1 R26752.1 R26753.1 R26754.1 R26755.1 R26756.1 R26757.1 R26758.1 R26759.1 R26760.1 R26761.1 R26762.1 R26763.1 R26764.1 R26765.1 R26766.1 R26767.1 R26768.1 R26769.1 R26770.1 R26771.1 R26772.1 R26773.1 R26774.1 R26775.1 R26776.1 R26777.1 R26778.1 R26779.1 R26780.1 R26781.1 R26782.1 R26783.1 R26784.1 R26785.1 R26786.1 R26787.1 R26788.1 R26789.1 R26790.1 R26791.1 R26792.1 R26793.1 R26794.1 R26795.1 R26796.1 R26797.1 R26798.1 R26799.1 R26800.1
N$143: R26601.2 R26602.2 R26603.2 R26604.2 R26605.2 R26606.2 R26607.2 R26608.2 R26609.2 R26610.2 R26611.2 R26612.2 R26613.2 R26614.2 R26615.2 R26616.2 R26617.2 R26618.2 R26619.2 R26620.2 R26621.2 R26622.2 R26623.2 R26624.2 R26625.2 R26626.2 R26627.2 R26628.2 R26629.2 R26630.2 R26631.2 R26632.2 R26633.2 R26634.2 R26635.2 R26636.2 R26637.2 R26638.2 R26639.2 R26640.2 R26641.2 R26642.2 R26643.2 R26644.2 R26645.2 R26646.2 R26647.2 R26648.2 R26649.2 R26650.2 R26651.2 R26652.2 R26653.2 R26654.2 R26655.2 R26656.2 R26657.2 R26658.2 R26659.2 R26660.2 R26661.2 R26662.2 R26663.2 R26664.2 R26665.2 R26666.2 R26667.2 R26668.2 R26669.2 R26670.2 R26671.2 R26672.2 R26673.2 R26674.2 R26675.2 R26676.2 R26677.2 R26678.2 R26679.2 R26680.2 R26681.2 R26682.2 R26683.2 R26684.2 R26685.2 R26686.2 R26687.2 R26688.2 R26689.2 R26690.2 R26691.2 R26692.2 R26693.2 R26694.2 R26695.2 R26696.2 R26697.2 R26698.2 R26699.2 R26700.2 R26701.2 R26702.2 R26703.2 R26704.2 R26705.2 R26706.2 R26707.2 R26708.2 R26709.2 R26710.2 R26711.2 R26712.2 R26713.2 R26714.2 R26715.2 R26716.2 R26717.2 R26718.2 R26719.2 R26720.2 R26721.2 R26722.2 R26723.2 R26724.2 R26725.2 R26726.2 R26727.2 R26728.2 R26729.2 R26730.2 R26731.2 R26732.2 R26733.2 R26734.2 R26735.2 R26736.2 R26737.2 R26738.2 R26739.2 R26740.2 R26741.2 R26742.2 R26743.2 R26744.2 R26745.2 R26746.2 R26747.2 R26748.2 R26749.2 R26750.2 R26751.2 R26752.2 R26753.2 R26754.2 R26755.2 R26756.2 R26757.2 R26758.2 R26759.2 R26760.2 R26761.2 R26762.2 R26763.2 R26764.2 R26765.2 R26766.2 R26767.2 R26768.2 R26769.2 R26770.2 R26771.2 R26772.2 R26773.2 R26774.2 R26775.2 R26776.2 R26777.2 R26778.2 R26779.2 R26780.2 R26781.2 R26782.2 R26783.2 R26784.2 R26785.2 R26786.2 R26787.2 R26788.2 R26789.2 R26790.2 R26791.2 R26792.2 R26793.2 R26794.2 R26795.2 R26796.2 R26797.2 R26798.2 R26799.2 R26800.2 R26801.1 R26802.1 R26803.1 R26804.1 R26805.1 R26806.1 R26807.1 R26808.1 R26809.1 R26810.1 R26811.1 R26812.1 R26813.1 R26814.1 R26815.1 R26816.1 R26817.1 R26818.1 R26819.1 R26820.1 R26821.1 R26822.1 R26823.1 R26824.1 R26825.1 R26826.1 R26827.1 R26828.1 R26829.1 R26830.1 R26831.1 R26832.1 R26833.1 R26834.1 R26835.1 R26836.1 R26837.1 R26838.1 R26839.1 R26840.1 R26841.1 R26842.1 R26843.1 R26844.1 R26845.1 R26846.1 R26847.1 R26848.1 R26849.1 R26850.1 R26851.1 R26852.1 R26853.1 R26854.1 R26855.1 R26856.1 R26857.1 R26858.1 R26859.1 R26860.1 R26861.1 R26862.1 R26863.1 R26864.1 R26865.1 R26866.1 R26867.1 R26868.1 R26869.1 R26870.1 R26871.1 R26872.1 R26873.1 R26874.1 R26875.1 R26876.1 R26877.1 R26878.1 R26879.1 R26880.1 R26881.1 R26882.1 R26883.1 R26884.1 R26885.1 R26886.1 R26887.1 R26888.1 R26889.1 R26890.1 R26891.1 R26892.1 R26893.1 R26894.1 R26895.1 R26896.1 R26897.1 R26898.1 R26899.1 R26900.1 R26901.1 R26902.1 R26903.1 R26904.1 R26905.1 R26906.1 R26907.1 R26908.1 R26909.1 R26910.1 R26911.1 R26912.1 R26913.1 R26914.1 R26915.1 R26916.1 R26917.1 R26918.1 R26919.1 R26920.1 R26921.1 R26922.1 R26923.1 R26924.1 R26925.1 R26926.1 R26927.1 R26928.1 R26929.1 R26930.1 R26931.1 R26932.1 R26933.1 R26934.1 R26935.1 R26936.1 R26937.1 R26938.1 R26939.1 R26940.1 R26941.1 R26942.1 R26943.1 R26944.1 R26945.1 R26946.1 R26947.1 R26948.1 R26949.1 R26950.1 R26951.1 R26952.1 R26953.1 R26954.1 R26955.1 R26956.1 R26957.1 R26958.1 R26959.1 R26960.1 R26961.1 R26962.1 R26963.1 R26964.1 R26965.1 R26966.1 R26967.1 R26968.1 R26969.1 R26970.1 R26971.1 R26972.1 R26973.1 R26974.1 R26975.1 R26976.1 R26977.1 R26978.1 R26979.1 R26980.1 R26981.1 R26982.1 R26983.1 R26984.1 R26985.1 R26986.1 R26987.1 R26988.1 R26989.1 R26990.1 R26991.1 R26992.1 R26993.1 R26994.1 R26995.1 R26996.1 R26997.1 R26998.1 R26999.1 R27000.1
N$144: R26801.2 R26802.2 R26803.2 R26804.2 R26805.2 R26806.2 R26807.2 R26808.2 R26809.2 R26810.2 R26811.2 R26812.2 R26813.2 R26814.2 R26815.2 R26816.2 R26817.2 R26818.2 R26819.2 R26820.2 R26821.2 R26822.2 R26823.2 R26824.2 R26825.2 R26826.2 R26827.2 R26828.2 R26829.2 R26830.2 R26831.2 R26832.2 R26833.2 R26834.2 R26835.2 R26836.2 R26837.2 R26838.2 R26839.2 R26840.2 R26841.2 R26842.2 R26843.2 R26844.2 R26845.2 R26846.2 R26847.2 R26848.2 R26849.2 R26850.2 R26851.2 R26852.2 R26853.2 R26854.2 R26855.2 R26856.2 R26857.2 R26858.2 R26859.2 R26860.2 R26861.2 R26862.2 R26863.2 R26864.2 R26865.2 R26866.2 R26867.2 R26868.2 R26869.2 R26870.2 R26871.2 R26872.2 R26873.2 R26874.2 R26875.2 R26876.2 R26877.2 R26878.2 R26879.2 R26880.2 R26881.2 R26882.2 R26883.2 R26884.2 R26885.2 R26886.2 R26887.2 R26888.2 R26889.2 R26890.2 R26891.2 R26892.2 R26893.2 R26894.2 R26895.2 R26896.2 R26897.2 R26898.2 R26899.2 R26900.2 R26901.2 R26902.2 R26903.2 R26904.2 R26905.2 R26906.2 R26907.2 R26908.2 R26909.2 R26910.2 R26911.2 R26912.2 R26913.2 R26914.2 R26915.2 R26916.2 R26917.2 R26918.2 R26919.2 R26920.2 R26921.2 R26922.2 R26923.2 R26924.2 R26925.2 R26926.2 R26927.2 R26928.2 R26929.2 R26930.2 R26931.2 R26932.2 R26933.2 R26934.2 R26935.2 R26936.2 R26937.2 R26938.2 R26939.2 R26940.2 R26941.2 R26942.2 R26943.2 R26944.2 R26945.2 R26946.2 R26947.2 R26948.2 R26949.2 R26950.2 R26951.2 R26952.2 R26953.2 R26954.2 R26955.2 R26956.2 R26957.2 R26958.2 R26959.2 R26960.2 R26961.2 R26962.2 R26963.2 R26964.2 R26965.2 R26966.2 R26967.2 R26968.2 R26969.2 R26970.2 R26971.2 R26972.2 R26973.2 R26974.2 R26975.2 R26976.2 R26977.2 R26978.2 R26979.2 R26980.2 R26981.2 R26982.2 R26983.2 R26984.2 R26985.2 R26986.2 R26987.2 R26988.2 R26989.2 R26990.2 R26991.2 R26992.2 R26993.2 R26994.2 R26995.2 R26996.2 R26997.2 R26998.2 R26999.2 R27000.2 R27001.1 R27002.1 R27003.1 R27004.1 R27005.1 R27006.1 R27007.1 R27008.1 R27009.1 R27010.1 R27011.1 R27012.1 R27013.1 R27014.1 R27015.1 R27016.1 R27017.1 R27018.1 R27019.1 R27020.1 R27021.1 R27022.1 R27023.1 R27024.1 R27025.1 R27026.1 R27027.1 R27028.1 R27029.1 R27030.1 R27031.1 R27032.1 R27033.1 R27034.1 R27035.1 R27036.1 R27037.1 R27038.1 R27039.1 R27040.1 R27041.1 R27042.1 R27043.1 R27044.1 R27045.1 R27046.1 R27047.1 R27048.1 R27049.1 R27050.1 R27051.1 R27052.1 R27053.1 R27054.1 R27055.1 R27056.1 R27057.1 R27058.1 R27059.1 R27060.1 R27061.1 R27062.1 R27063.1 R27064.1 R27065.1 R27066.1 R27067.1 R27068.1 R27069.1 R27070.1 R27071.1 R27072.1 R27073.1 R27074.1 R27075.1 R27076.1 R27077.1 R27078.1 R27079.1 R27080.1 R27081.1 R27082.1 R27083.1 R27084.1 R27085.1 R27086.1 R27087.1 R27088.1 R27089.1 R27090.1 R27091.1 R27092.1 R27093.1 R27094.1 R27095.1 R27096.1 R27097.1 R27098.1 R27099.1 R27100.1 R27101.1 R27102.1 R27103.1 R27104.1 R27105.1 R27106.1 R27107.1 R27108.1 R27109.1 R27110.1 R27111.1 R27112.1 R27113.1 R27114.1 R27115.1 R27116.1 R27117.1 R27118.1 R27119.1 R27120.1 R27121.1 R27122.1 R27123.1 R27124.1 R27125.1 R27126.1 R27127.1 R27128.1 R27129.1 R27130.1 R27131.1 R27132.1 R27133.1 R27134.1 R27135.1 R27136.1 R27137.1 R27138.1 R27139.1 R27140.1 R27141.1 R27142.1 R27143.1 R27144.1 R27145.1 R27146.1 R27147.1 R27148.1 R27149.1 R27150.1 R27151.1 R27152.1 R27153.1 R27154.1 R27155.1 R27156.1 R27157.1 R27158.1 R27159.1 R27160.1 R27161.1 R27162.1 R27163.1 R27164.1 R27165.1 R27166.1 R27167.1 R27168.1 R27169.1 R27170.1 R27171.1 R27172.1 R27173.1 R27174.1 R27175.1 R27176.1 R27177.1 R27178.1 R27179.1 R27180.1 R27181.1 R27182.1 R27183.1 R27184.1 R27185.1 R27186.1 R27187.1 R27188.1 R27189.1 R27190.1 R27191.1 R27192.1 R27193.1 R27194.1 R27195.1 R27196.1 R27197.1 R27198.1 R27199.1 R27200.1
N$145: R27001.2 R27002.2 R27003.2 R27004.2 R27005.2 R27006.2 R27007.2 R27008.2 R27009.2 R27010.2 R27011.2 R27012.2 R27013.2 R27014.2 R27015.2 R27016.2 R27017.2 R27018.2 R27019.2 R27020.2 R27021.2 R27022.2 R27023.2 R27024.2 R27025.2 R27026.2 R27027.2 R27028.2 R27029.2 R27030.2 R27031.2 R27032.2 R27033.2 R27034.2 R27035.2 R27036.2 R27037.2 R27038.2 R27039.2 R27040.2 R27041.2 R27042.2 R27043.2 R27044.2 R27045.2 R27046.2 R27047.2 R27048.2 R27049.2 R27050.2 R27051.2 R27052.2 R27053.2 R27054.2 R27055.2 R27056.2 R27057.2 R27058.2 R27059.2 R27060.2 R27061.2 R27062.2 R27063.2 R27064.2 R27065.2 R27066.2 R27067.2 R27068.2 R27069.2 R27070.2 R27071.2 R27072.2 R27073.2 R27074.2 R27075.2 R27076.2 R27077.2 R27078.2 R27079.2 R27080.2 R27081.2 R27082.2 R27083.2 R27084.2 R27085.2 R27086.2 R27087.2 R27088.2 R27089.2 R27090.2 R27091.2 R27092.2 R27093.2 R27094.2 R27095.2 R27096.2 R27097.2 R27098.2 R27099.2 R27100.2 R27101.2 R27102.2 R27103.2 R27104.2 R27105.2 R27106.2 R27107.2 R27108.2 R27109.2 R27110.2 R27111.2 R27112.2 R27113.2 R27114.2 R27115.2 R27116.2 R27117.2 R27118.2 R27119.2 R27120.2 R27121.2 R27122.2 R27123.2 R27124.2 R27125.2 R27126.2 R27127.2 R27128.2 R27129.2 R27130.2 R27131.2 R27132.2 R27133.2 R27134.2 R27135.2 R27136.2 R27137.2 R27138.2 R27139.2 R27140.2 R27141.2 R27142.2 R27143.2 R27144.2 R27145.2 R27146.2 R27147.2 R27148.2 R27149.2 R27150.2 R27151.2 R27152.2 R27153.2 R27154.2 R27155.2 R27156.2 R27157.2 R27158.2 R27159.2 R27160.2 R27161.2 R27162.2 R27163.2 R27164.2 R27165.2 R27166.2 R27167.2 R27168.2 R27169.2 R27170.2 R27171.2 R27172.2 R27173.2 R27174.2 R27175.2 R27176.2 R27177.2 R27178.2 R27179.2 R27180.2 R27181.2 R27182.2 R27183.2 R27184.2 R27185.2 R27186.2 R27187.2 R27188.2 R27189.2 R27190.2 R27191.2 R27192.2 R27193.2 R27194.2 R27195.2 R27196.2 R27197.2 R27198.2 R27199.2 R27200.2 R27201.1 R27202.1 R27203.1 R27204.1 R27205.1 R27206.1 R27207.1 R27208.1 R27209.1 R27210.1 R27211.1 R27212.1 R27213.1 R27214.1 R27215.1 R27216.1 R27217.1 R27218.1 R27219.1 R27220.1 R27221.1 R27222.1 R27223.1 R27224.1 R27225.1 R27226.1 R27227.1 R27228.1 R27229.1 R27230.1 R27231.1 R27232.1 R27233.1 R27234.1 R27235.1 R27236.1 R27237.1 R27238.1 R27239.1 R27240.1 R27241.1 R27242.1 R27243.1 R27244.1 R27245.1 R27246.1 R27247.1 R27248.1 R27249.1 R27250.1 R27251.1 R27252.1 R27253.1 R27254.1 R27255.1 R27256.1 R27257.1 R27258.1 R27259.1 R27260.1 R27261.1 R27262.1 R27263.1 R27264.1 R27265.1 R27266.1 R27267.1 R27268.1 R27269.1 R27270.1 R27271.1 R27272.1 R27273.1 R27274.1 R27275.1 R27276.1 R27277.1 R27278.1 R27279.1 R27280.1 R27281.1 R27282.1 R27283.1 R27284.1 R27285.1 R27286.1 R27287.1 R27288.1 R27289.1 R27290.1 R27291.1 R27292.1 R27293.1 R27294.1 R27295.1 R27296.1 R27297.1 R27298.1 R27299.1 R27300.1 R27301.1 R27302.1 R27303.1 R27304.1 R27305.1 R27306.1 R27307.1 R27308.1 R27309.1 R27310.1 R27311.1 R27312.1 R27313.1 R27314.1 R27315.1 R27316.1 R27317.1 R27318.1 R27319.1 R27320.1 R27321.1 R27322.1 R27323.1 R27324.1 R27325.1 R27326.1 R27327.1 R27328.1 R27329.1 R27330.1 R27331.1 R27332.1 R27333.1 R27334.1 R27335.1 R27336.1 R27337.1 R27338.1 R27339.1 R27340.1 R27341.1 R27342.1 R27343.1 R27344.1 R27345.1 R27346.1 R27347.1 R27348.1 R27349.1 R27350.1 R27351.1 R27352.1 R27353.1 R27354.1 R27355.1 R27356.1 R27357.1 R27358.1 R27359.1 R27360.1 R27361.1 R27362.1 R27363.1 R27364.1 R27365.1 R27366.1 R27367.1 R27368.1 R27369.1 R27370.1 R27371.1 R27372.1 R27373.1 R27374.1 R27375.1 R27376.1 R27377.1 R27378.1 R27379.1 R27380.1 R27381.1 R27382.1 R27383.1 R27384.1 R27385.1 R27386.1 R27387.1 R27388.1 R27389.1 R27390.1 R27391.1 R27392.1 R27393.1 R27394.1 R27395.1 R27396.1 R27397.1 R27398.1 R27399.1 R27400.1
N$146: R27201.2 R27202.2 R27203.2 R27204.2 R27205.2 R27206.2 R27207.2 R27208.2 R27209.2 R27210.2 R27211.2 R27212.2 R27213.2 R27214.2 R27215.2 R27216.2 R27217.2 R27218.2 R27219.2 R27220.2 R27221.2 R27222.2 R27223.2 R27224.2 R27225.2 R27226.2 R27227.2 R27228.2 R27229.2 R27230.2 R27231.2 R27232.2 R27233.2 R27234.2 R27235.2 R27236.2 R27237.2 R27238.2 R27239.2 R27240.2 R27241.2 R27242.2 R27243.2 R27244.2 R27245.2 R27246.2 R27247.2 R27248.2 R27249.2 R27250.2 R27251.2 R27252.2 R27253.2 R27254.2 R27255.2 R27256.2 R27257.2 R27258.2 R27259.2 R27260.2 R27261.2 R27262.2 R27263.2 R27264.2 R27265.2 R27266.2 R27267.2 R27268.2 R27269.2 R27270.2 R27271.2 R27272.2 R27273.2 R27274.2 R27275.2 R27276.2 R27277.2 R27278.2 R27279.2 R27280.2 R27281.2 R27282.2 R27283.2 R27284.2 R27285.2 R27286.2 R27287.2 R27288.2 R27289.2 R27290.2 R27291.2 R27292.2 R27293.2 R27294.2 R27295.2 R27296.2 R27297.2 R27298.2 R27299.2 R27300.2 R27301.2 R27302.2 R27303.2 R27304.2 R27305.2 R27306.2 R27307.2 R27308.2 R27309.2 R27310.2 R27311.2 R27312.2 R27313.2 R27314.2 R27315.2 R27316.2 R27317.2 R27318.2 R27319.2 R27320.2 R27321.2 R27322.2 R27323.2 R27324.2 R27325.2 R27326.2 R27327.2 R27328.2 R27329.2 R27330.2 R27331.2 R27332.2 R27333.2 R27334.2 R27335.2 R27336.2 R27337.2 R27338.2 R27339.2 R27340.2 R27341.2 R27342.2 R27343.2 R27344.2 R27345.2 R27346.2 R27347.2 R27348.2 R27349.2 R27350.2 R27351.2 R27352.2 R27353.2 R27354.2 R27355.2 R27356.2 R27357.2 R27358.2 R27359.2 R27360.2 R27361.2 R27362.2 R27363.2 R27364.2 R27365.2 R27366.2 R27367.2 R27368.2 R27369.2 R27370.2 R27371.2 R27372.2 R27373.2 R27374.2 R27375.2 R27376.2 R27377.2 R27378.2 R27379.2 R27380.2 R27381.2 R27382.2 R27383.2 R27384.2 R27385.2 R27386.2 R27387.2 R27388.2 R27389.2 R27390.2 R27391.2 R27392.2 R27393.2 R27394.2 R27395.2 R27396.2 R27397.2 R27398.2 R27399.2 R27400.2 R27401.1 R27402.1 R27403.1 R27404.1 R27405.1 R27406.1 R27407.1 R27408.1 R27409.1 R27410.1 R27411.1 R27412.1 R27413.1 R27414.1 R27415.1 R27416.1 R27417.1 R27418.1 R27419.1 R27420.1 R27421.1 R27422.1 R27423.1 R27424.1 R27425.1 R27426.1 R27427.1 R27428.1 R27429.1 R27430.1 R27431.1 R27432.1 R27433.1 R27434.1 R27435.1 R27436.1 R27437.1 R27438.1 R27439.1 R27440.1 R27441.1 R27442.1 R27443.1 R27444.1 R27445.1 R27446.1 R27447.1 R27448.1 R27449.1 R27450.1 R27451.1 R27452.1 R27453.1 R27454.1 R27455.1 R27456.1 R27457.1 R27458.1 R27459.1 R27460.1 R27461.1 R27462.1 R27463.1 R27464.1 R27465.1 R27466.1 R27467.1 R27468.1 R27469.1 R27470.1 R27471.1 R27472.1 R27473.1 R27474.1 R27475.1 R27476.1 R27477.1 R27478.1 R27479.1 R27480.1 R27481.1 R27482.1 R27483.1 R27484.1 R27485.1 R27486.1 R27487.1 R27488.1 R27489.1 R27490.1 R27491.1 R27492.1 R27493.1 R27494.1 R27495.1 R27496.1 R27497.1 R27498.1 R27499.1 R27500.1 R27501.1 R27502.1 R27503.1 R27504.1 R27505.1 R27506.1 R27507.1 R27508.1 R27509.1 R27510.1 R27511.1 R27512.1 R27513.1 R27514.1 R27515.1 R27516.1 R27517.1 R27518.1 R27519.1 R27520.1 R27521.1 R27522.1 R27523.1 R27524.1 R27525.1 R27526.1 R27527.1 R27528.1 R27529.1 R27530.1 R27531.1 R27532.1 R27533.1 R27534.1 R27535.1 R27536.1 R27537.1 R27538.1 R27539.1 R27540.1 R27541.1 R27542.1 R27543.1 R27544.1 R27545.1 R27546.1 R27547.1 R27548.1 R27549.1 R27550.1 R27551.1 R27552.1 R27553.1 R27554.1 R27555.1 R27556.1 R27557.1 R27558.1 R27559.1 R27560.1 R27561.1 R27562.1 R27563.1 R27564.1 R27565.1 R27566.1 R27567.1 R27568.1 R27569.1 R27570.1 R27571.1 R27572.1 R27573.1 R27574.1 R27575.1 R27576.1 R27577.1 R27578.1 R27579.1 R27580.1 R27581.1 R27582.1 R27583.1 R27584.1 R27585.1 R27586.1 R27587.1 R27588.1 R27589.1 R27590.1 R27591.1 R27592.1 R27593.1 R27594.1 R27595.1 R27596.1 R27597.1 R27598.1 R27599.1 R27600.1